# EasyEDA Pro project Project_first.eprj, schematic Schematic10
Create Date: 2024-06-27; Page Name: P1; Project Name: Project_first; Schematic Name: Schematic10; Update Date: 2024-06-28; Company: 嘉立创EDA; Page Size: A4; Version: V1.0
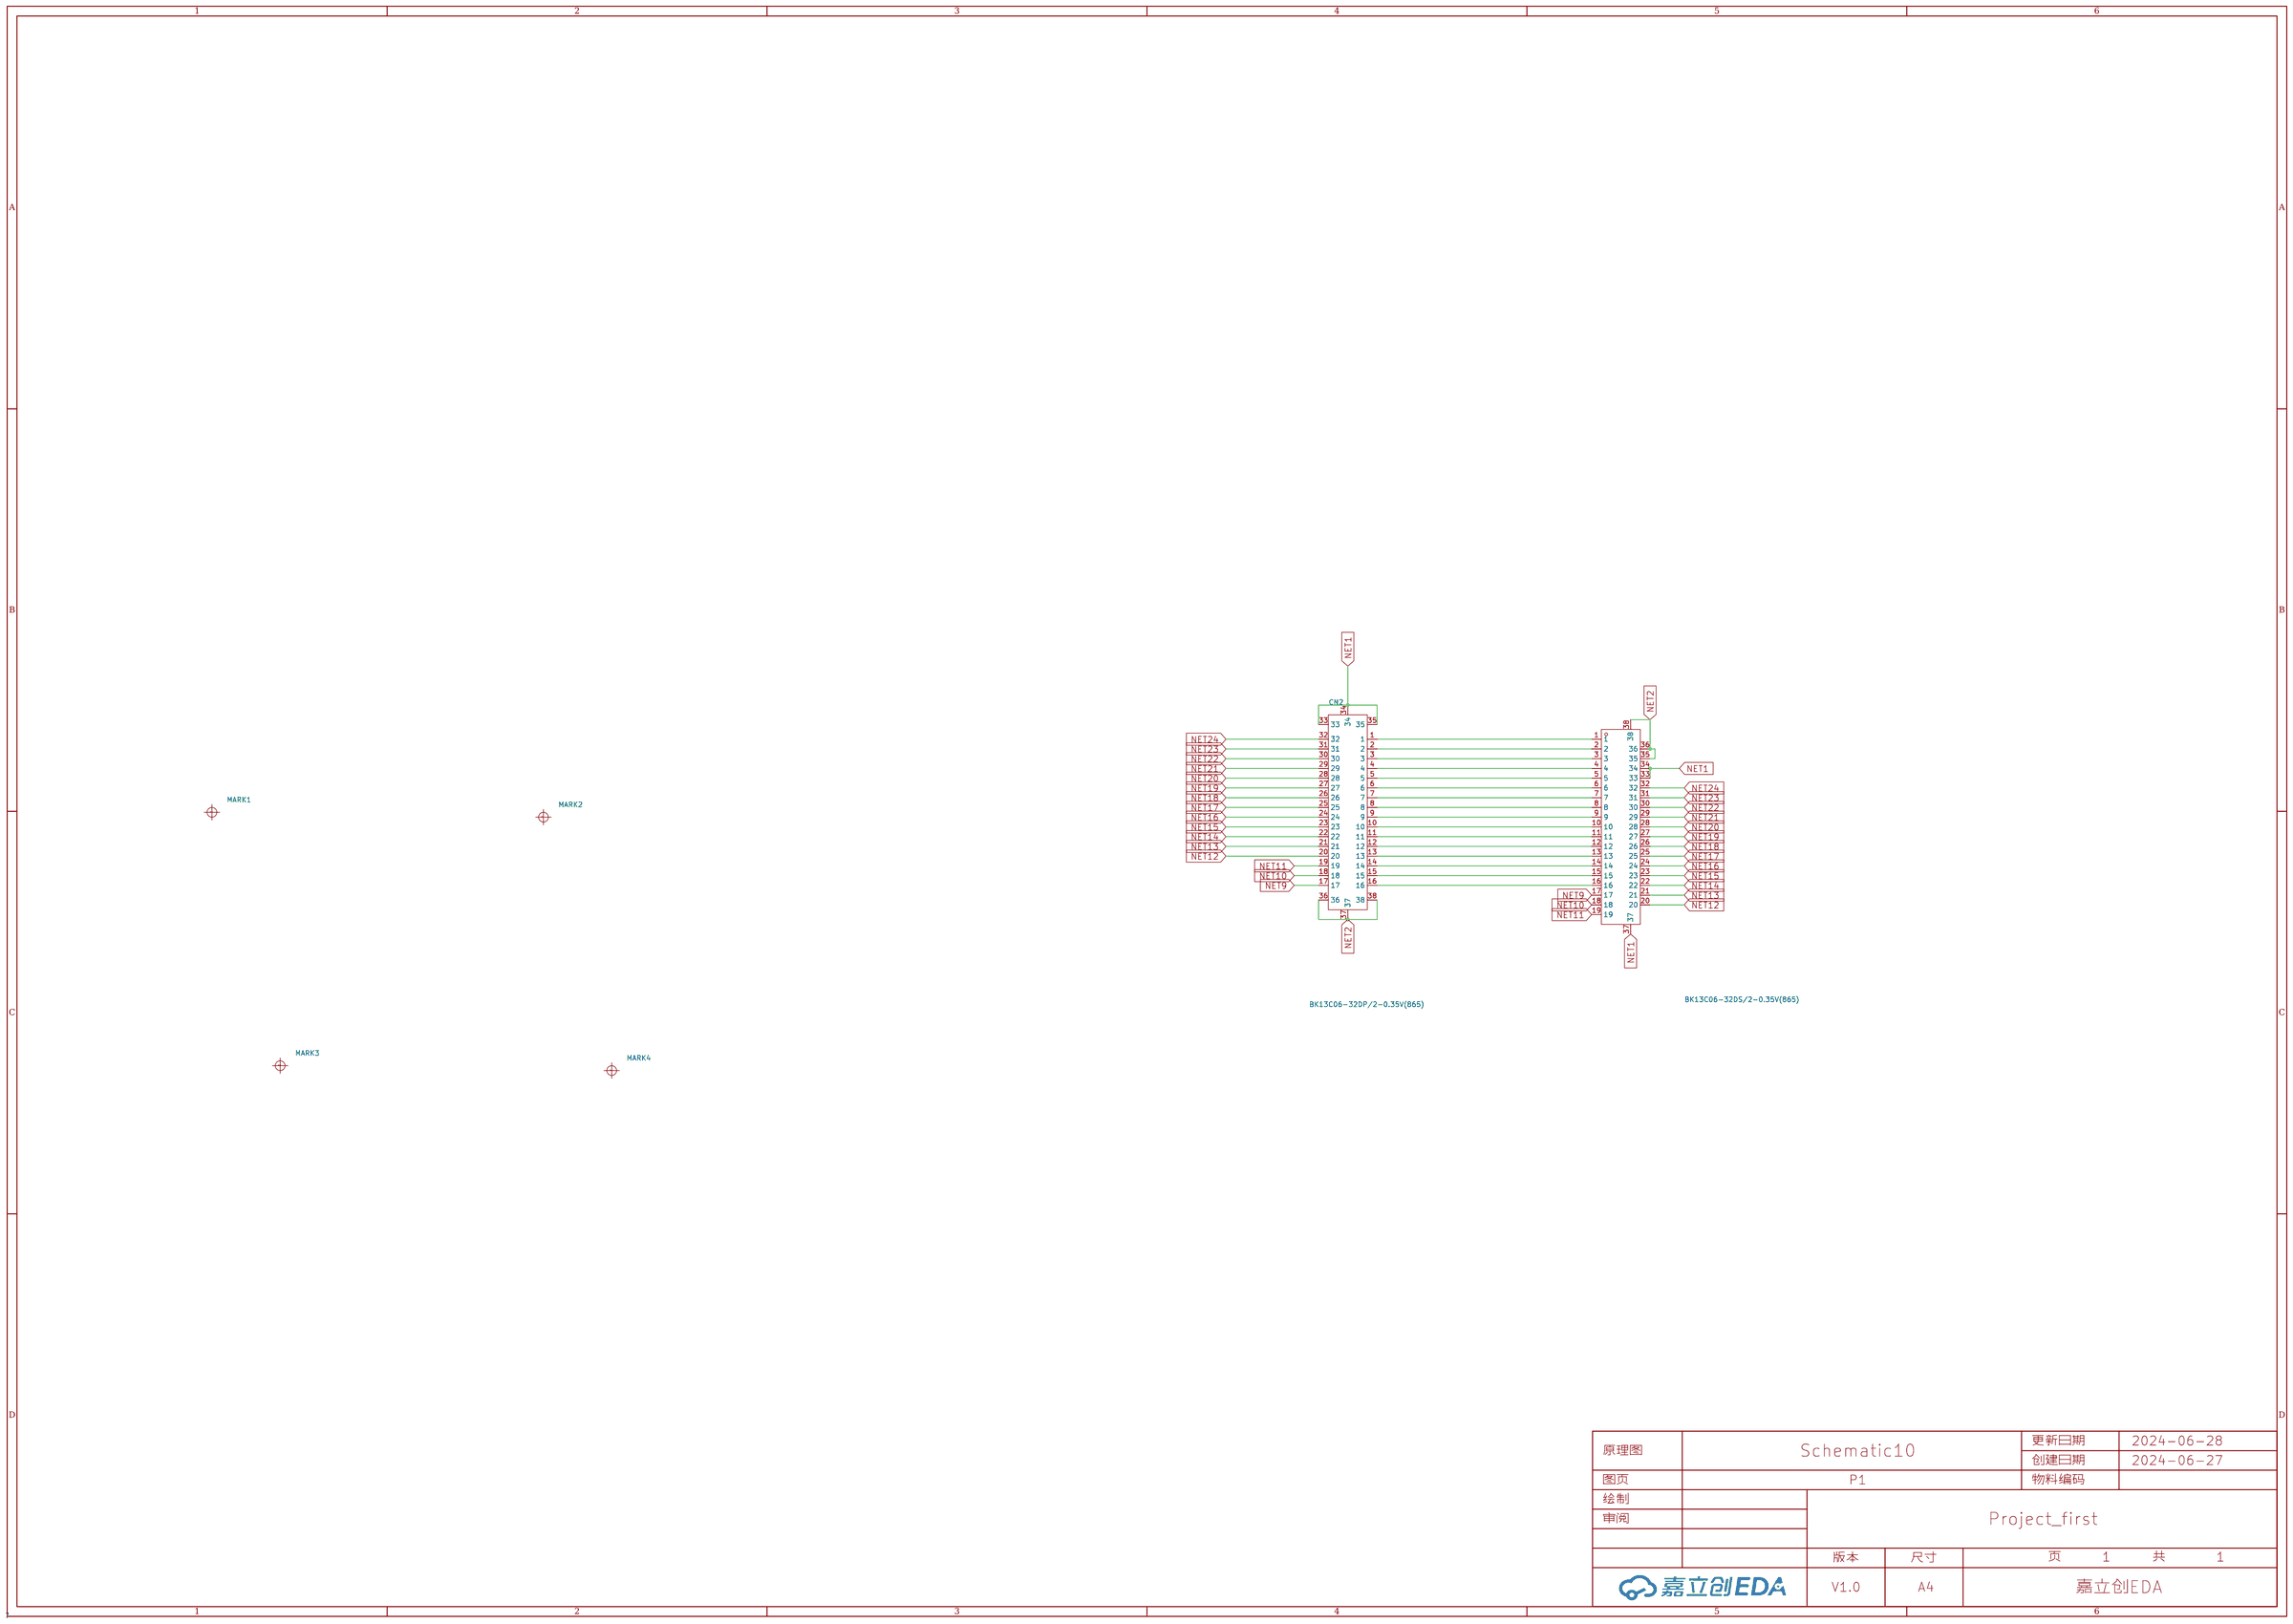
[diagram p17: schematic sheet]

## Parts
CN2  BK13C06-32DP/2-0.35V(865)  [CONN-SMD_BK13C06-32DP-2-0.35V]
MARK1  -  [Mark-Point-1mm]  (no BOM)
MARK2  -  [Mark-Point-1mm]  (no BOM)
MARK3  -  [Mark-Point-1mm]  (no BOM)
MARK4  -  [Mark-Point-1mm]  (no BOM)
U2  BK13C06-32DS/2-0.35V(865)  [CONN-SMD_32P-P0.35_HRS_BK13C06-32DS-2-0.35V]

## Library data of the parts
CN2 = BK13C06-32DP/2-0.35V(865): Supplier Part: C3031559; Manufacturer: HRS(广濑); JLCPCB Part Class: Extended Part; Supplier: LCSC
MARK1-MARK4 = Mark-Point: Mark点
U2 = BK13C06-32DS/2-0.35V(865): Supplier Part: C5296865; Manufacturer: HRS(广濑); JLCPCB Part Class: Extended Part; Datasheet: https://atta.szlcsc.com/upload/public/pdf/source/20231220/1024A2EC616EE310066069B8EBED3123.pdf; Supplier: LCSC

## Nets
NET1: CN2.33 CN2.34 CN2.35 U2.33 U2.34 U2.37
NET2: CN2.36 CN2.37 CN2.38 U2.35 U2.36 U2.38
NET9: CN2.17 U2.17
NET10: CN2.18 U2.18
NET11: CN2.19 U2.19
NET12: CN2.20 U2.20
NET13: CN2.21 U2.21
NET14: CN2.22 U2.22
NET15: CN2.23 U2.23
NET16: CN2.24 U2.24
NET17: CN2.25 U2.25
NET18: CN2.26 U2.26
NET19: CN2.27 U2.27
NET20: CN2.28 U2.28
NET21: CN2.29 U2.29
NET22: CN2.30 U2.30
NET23: CN2.31 U2.31
NET24: CN2.32 U2.32
$1N5318: CN2.1 U2.1
$1N5319: CN2.2 U2.2
$1N5320: CN2.3 U2.3
$1N5321: CN2.4 U2.4
$1N5322: CN2.5 U2.5
$1N5323: CN2.6 U2.6
$1N5324: CN2.7 U2.7
$1N5325: CN2.8 U2.8
$1N5326: CN2.9 U2.9
$1N5327: CN2.10 U2.10
$1N5328: CN2.11 U2.11
$1N5329: CN2.12 U2.12
$1N5330: CN2.13 U2.13
$1N5331: CN2.14 U2.14
$1N5332: CN2.15 U2.15
$1N5333: CN2.16 U2.16

Not connected (* = marked no-connect by the designer): MARK1 1; MARK2 1; MARK3 1; MARK4 1
